# Altium schematic sheet Minion.SchDoc (part 1 of 4)
size A0
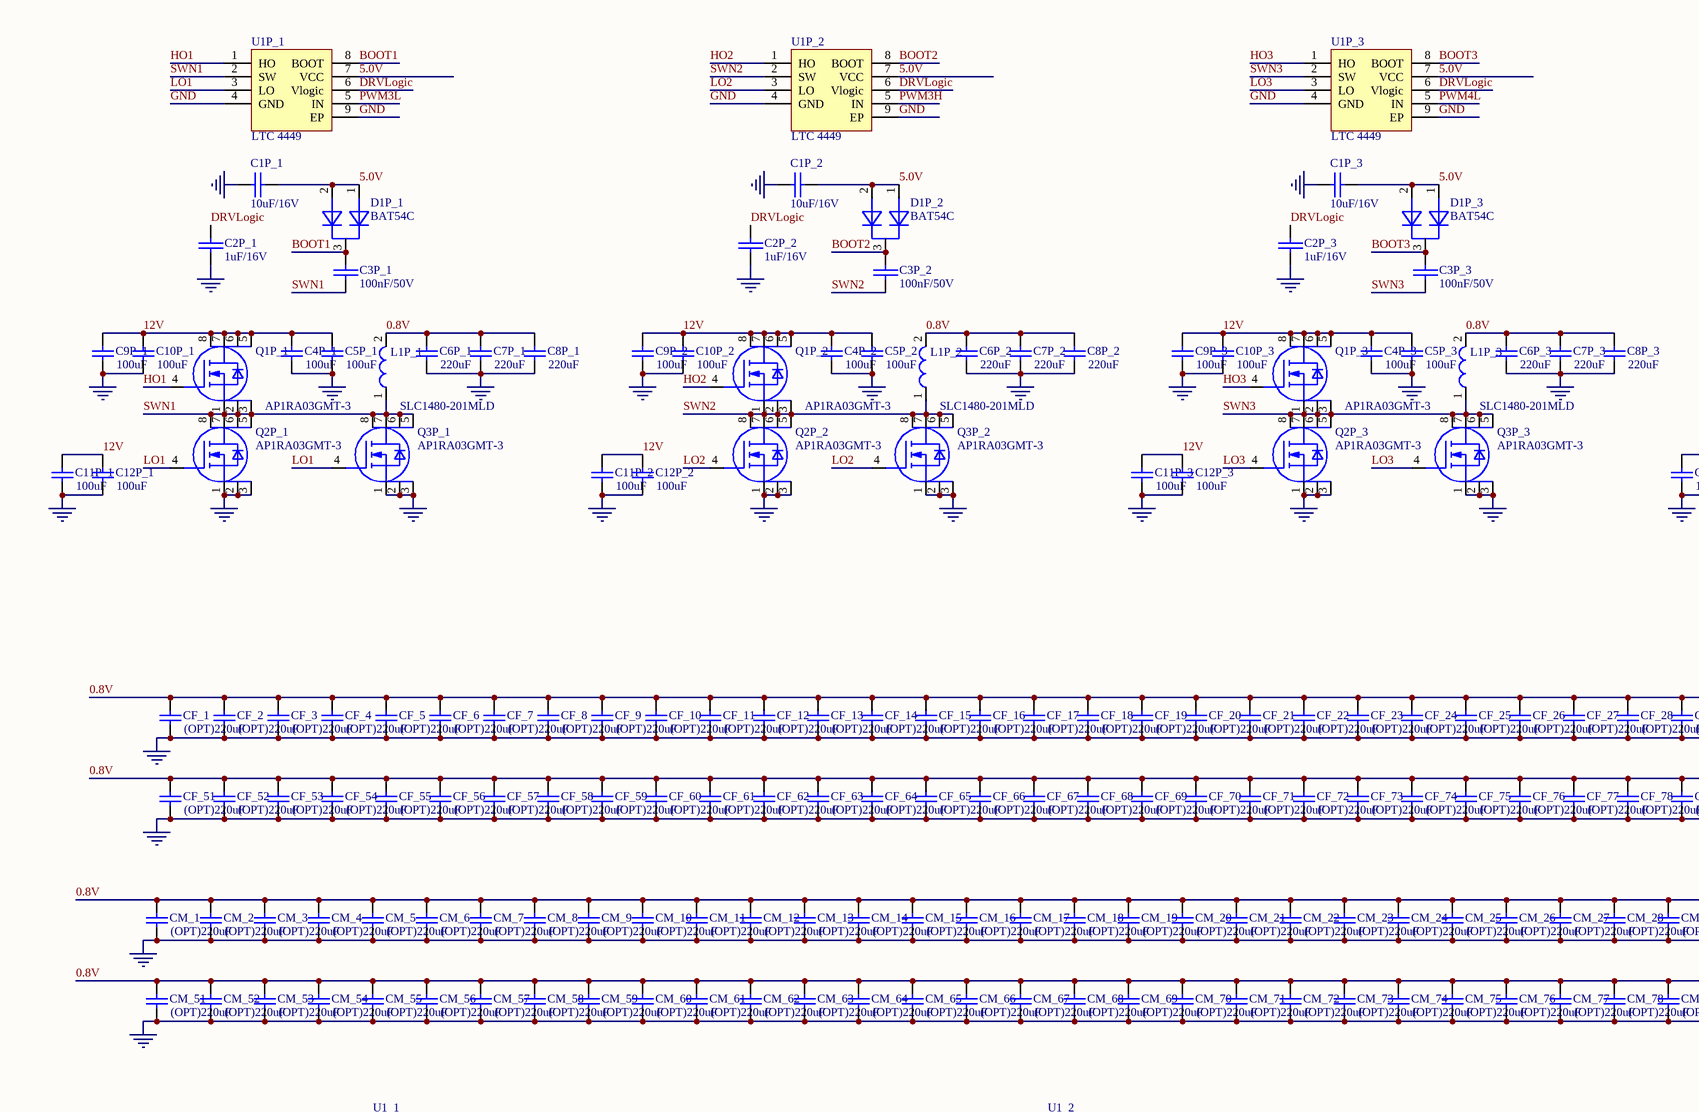
[diagram p0: Minion.SchDoc, top left]
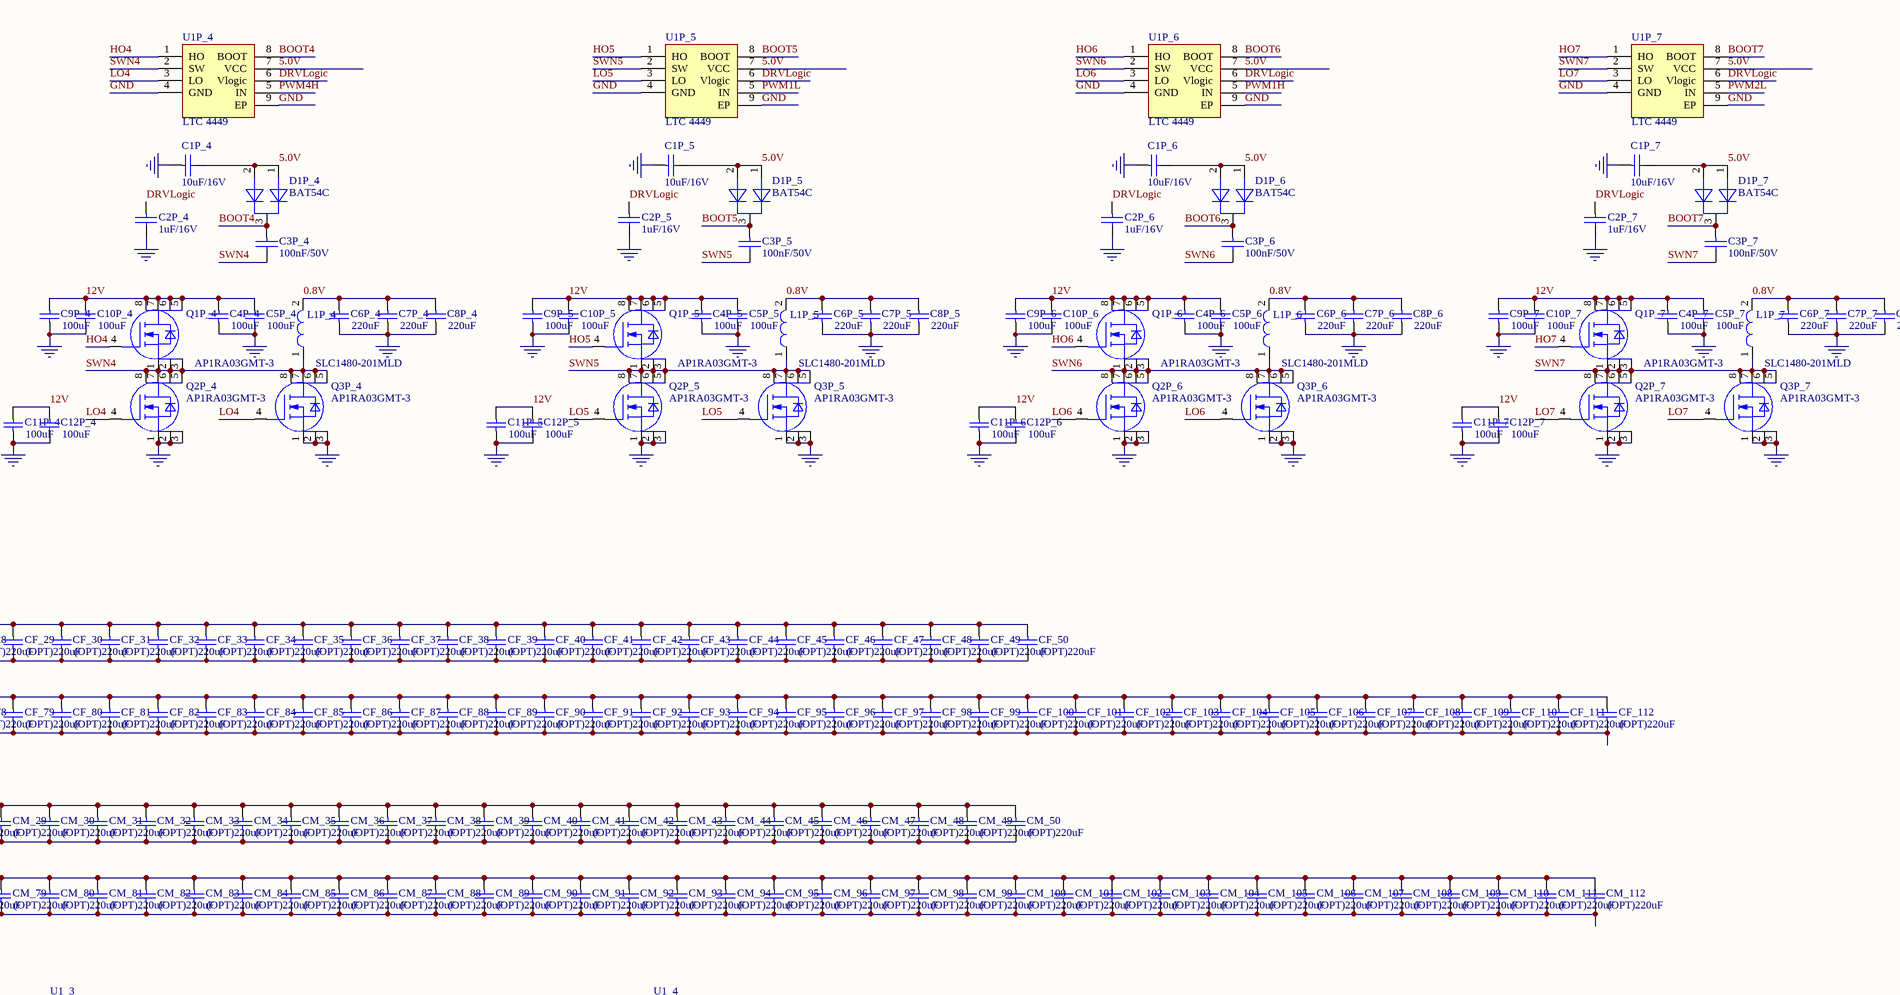
[diagram p1: Minion.SchDoc, top middle]
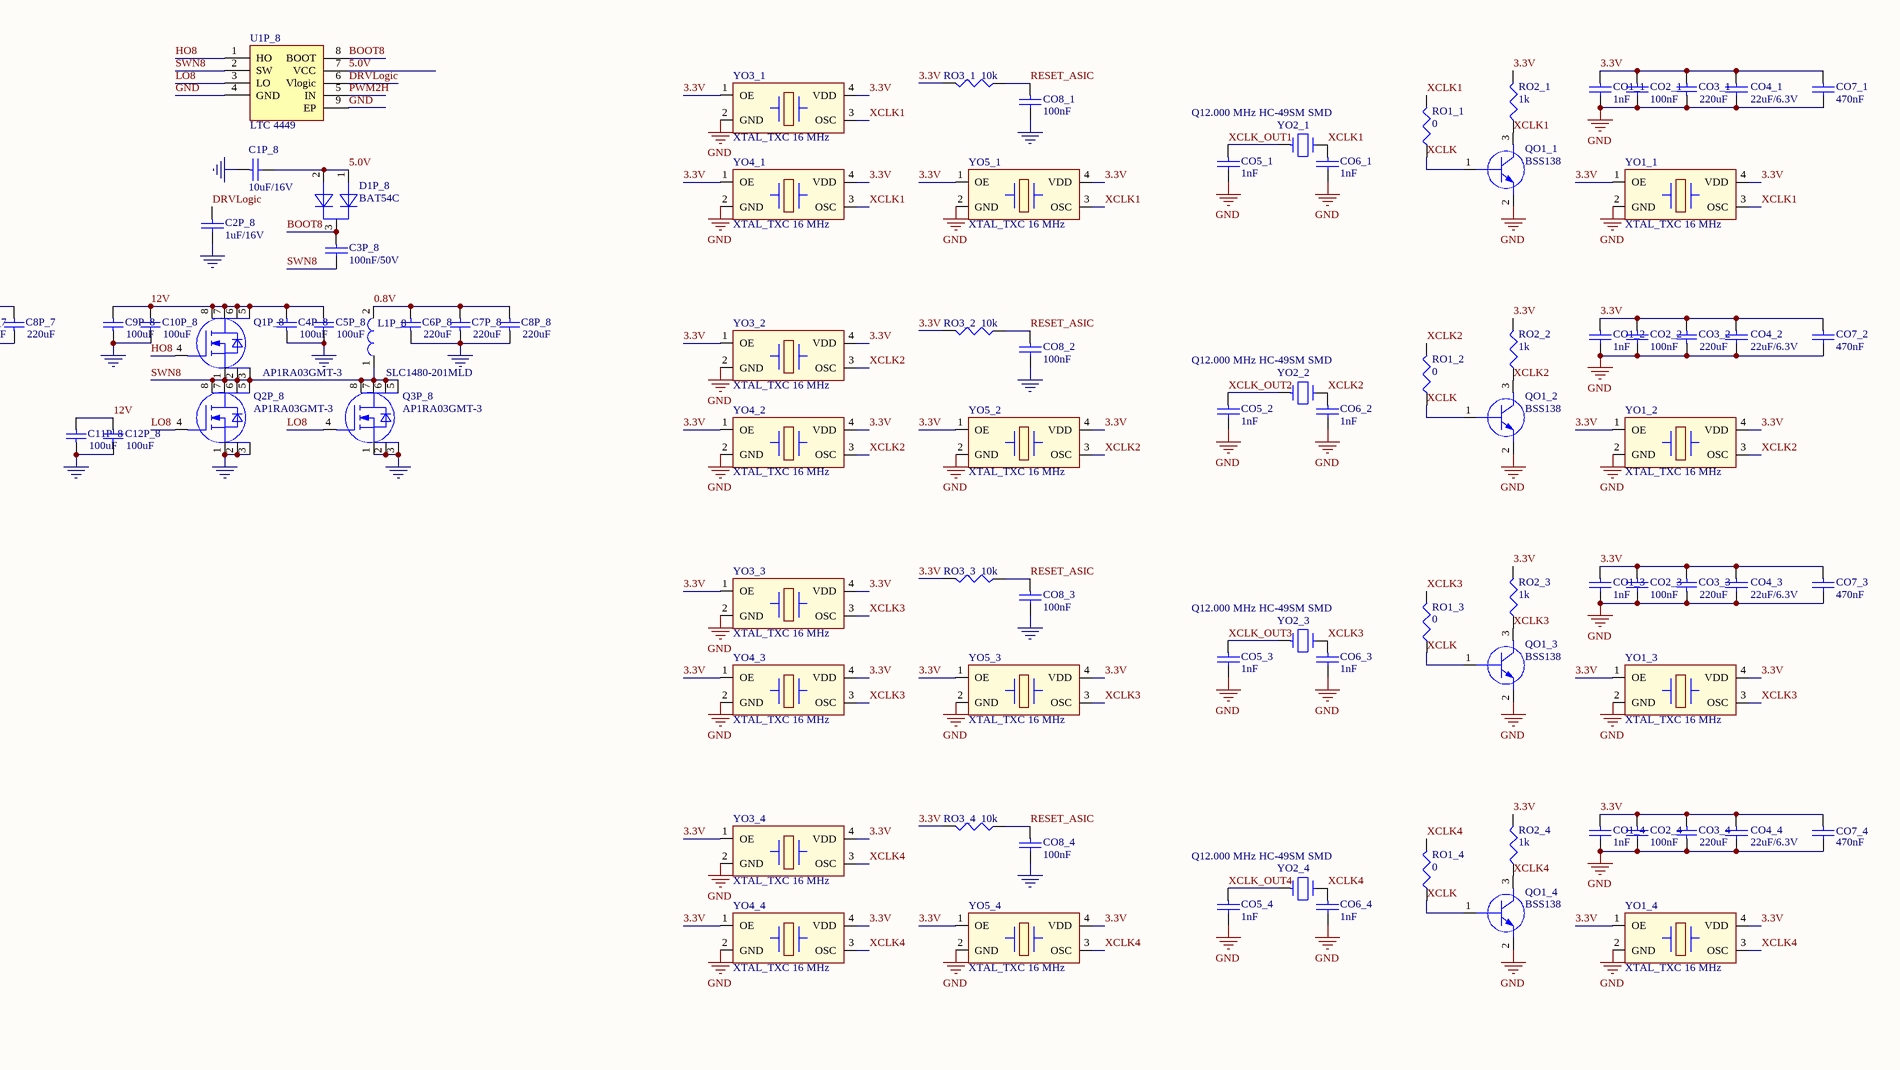
[diagram p2: Minion.SchDoc, top right]
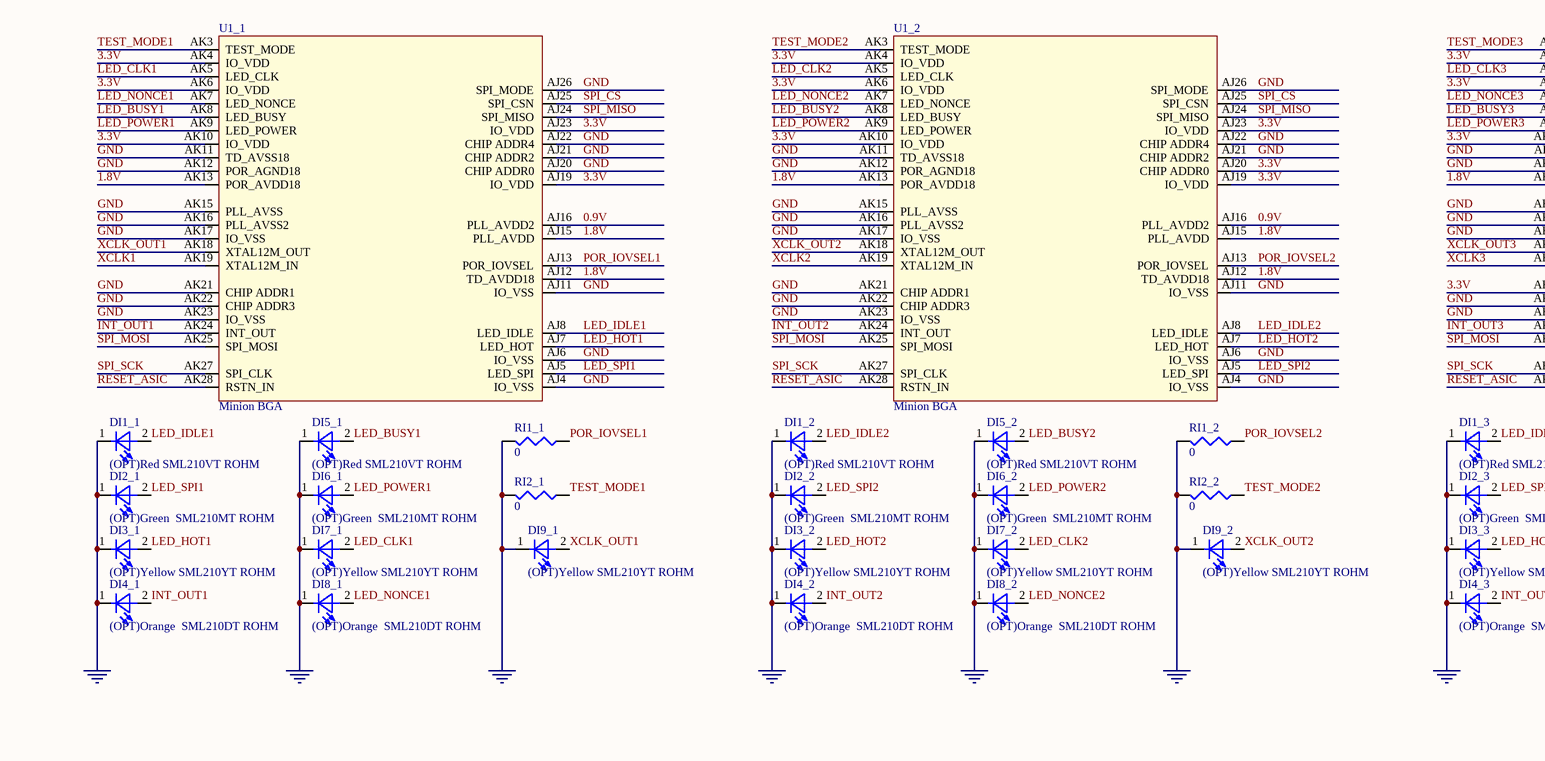
[diagram p3: Minion.SchDoc, bottom left]
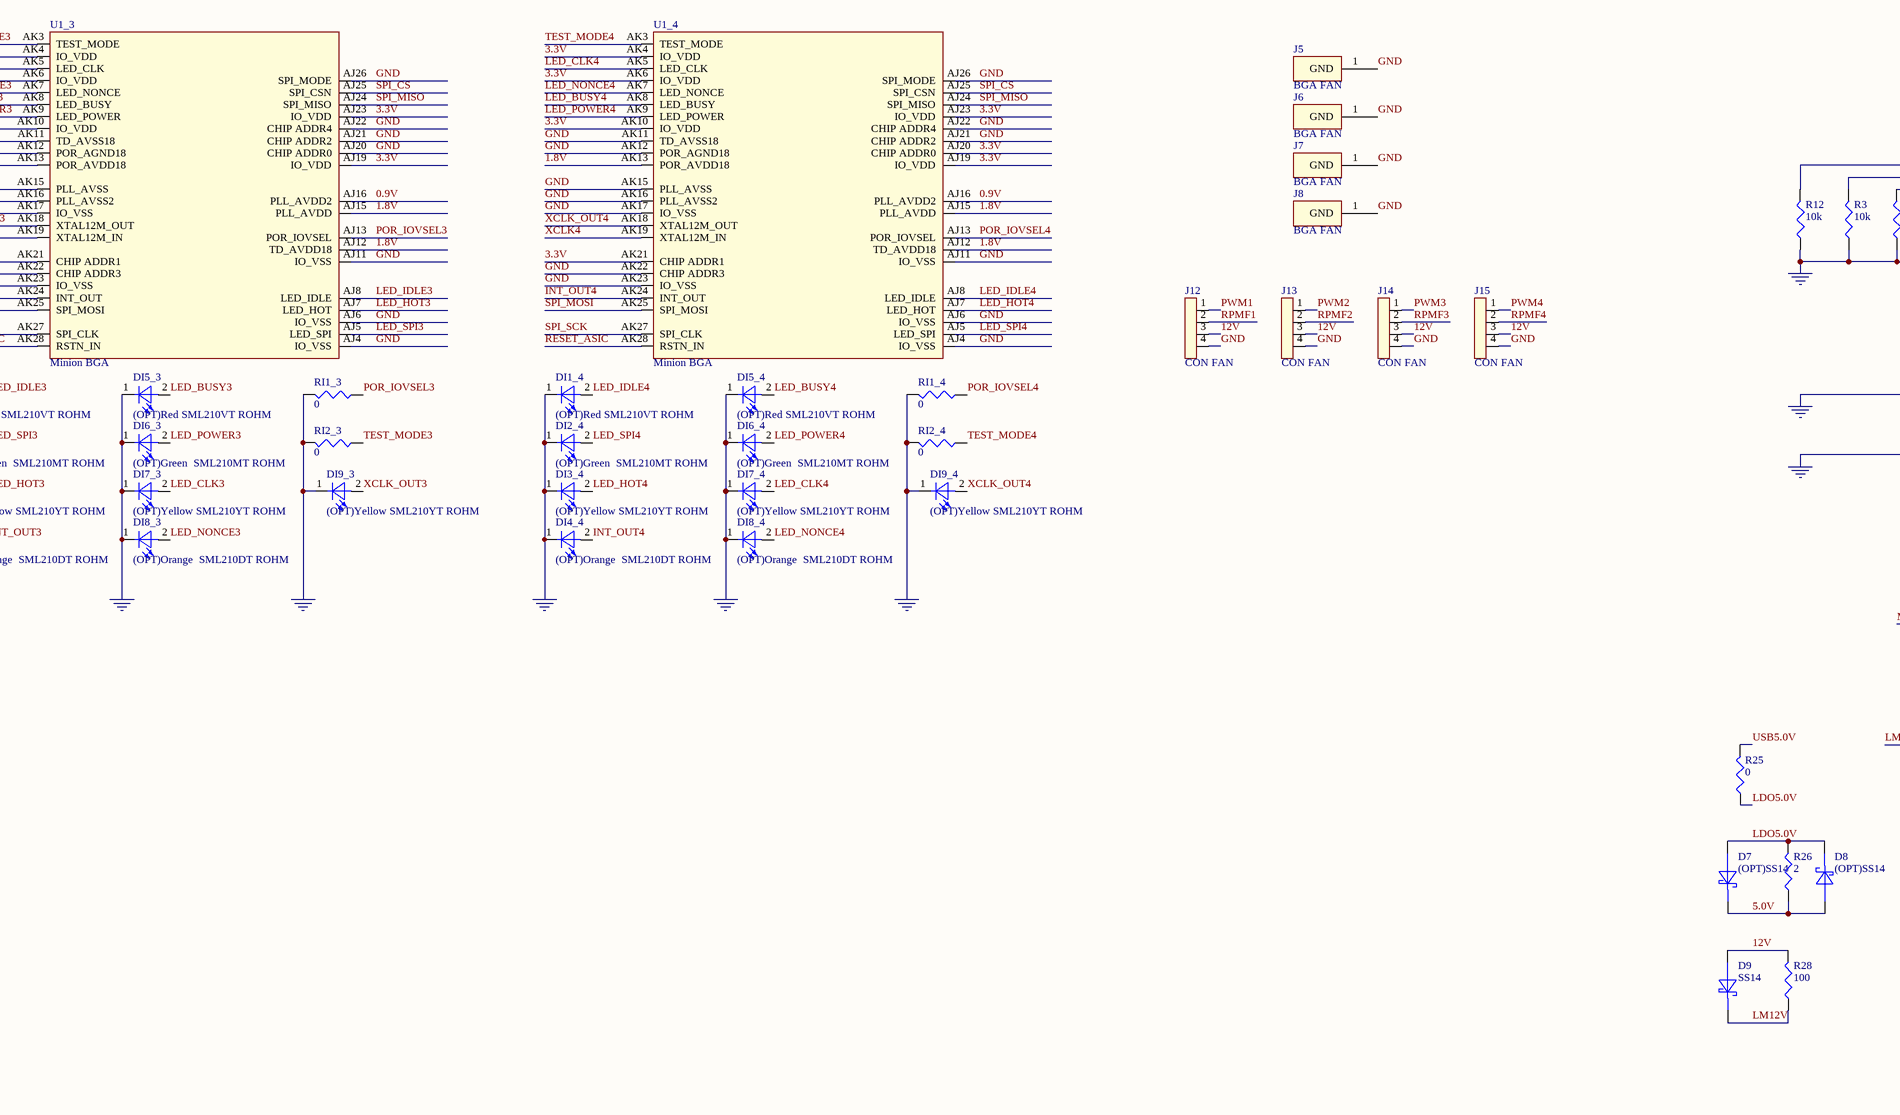
[diagram p4: Minion.SchDoc, bottom middle]
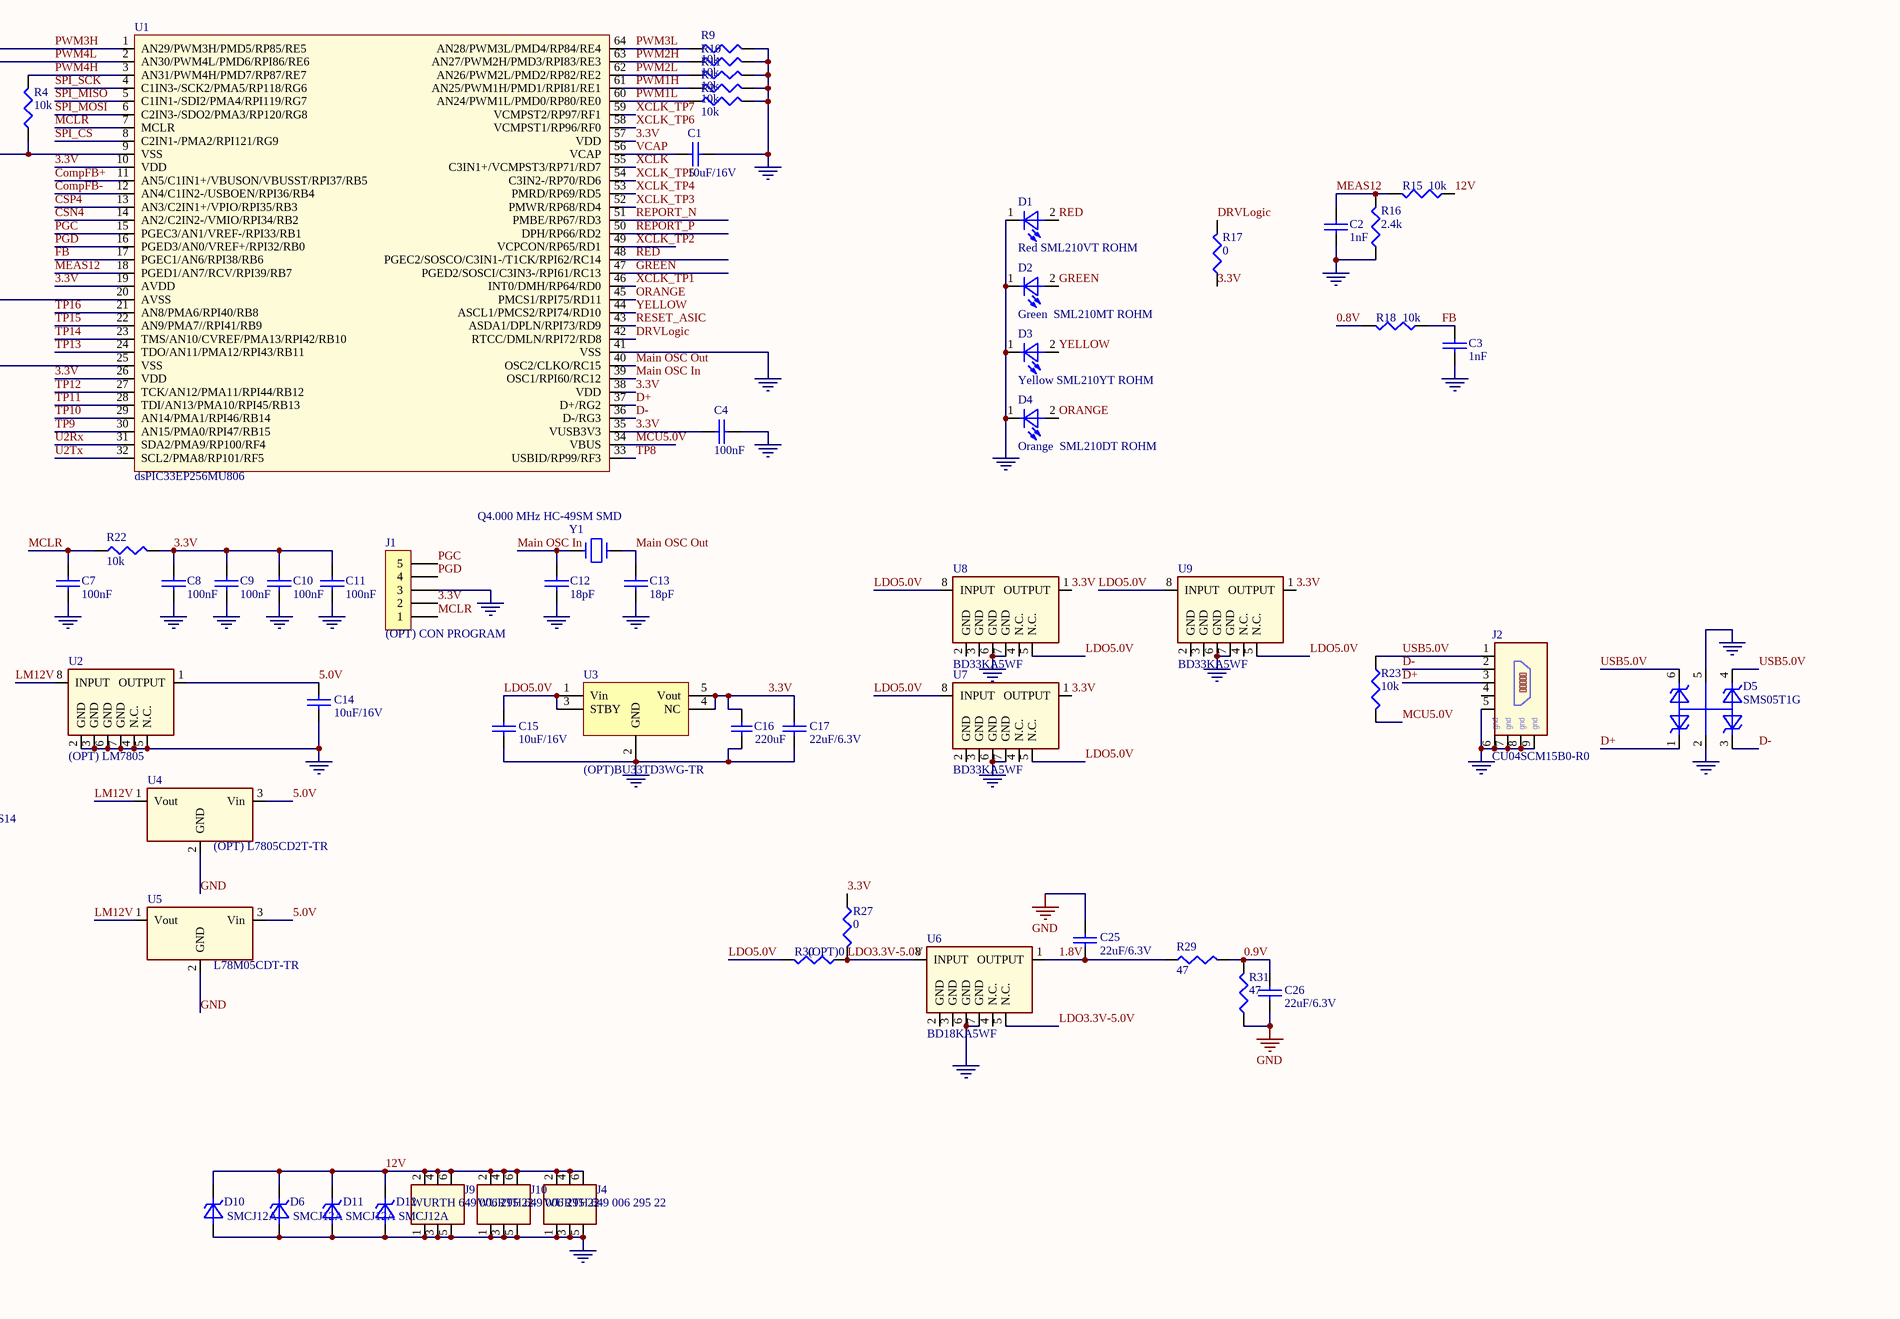
[diagram p5: Minion.SchDoc, bottom right]
